# EasyEDA Pro project FOX_HTOL_1.0.eprj, board PCB1
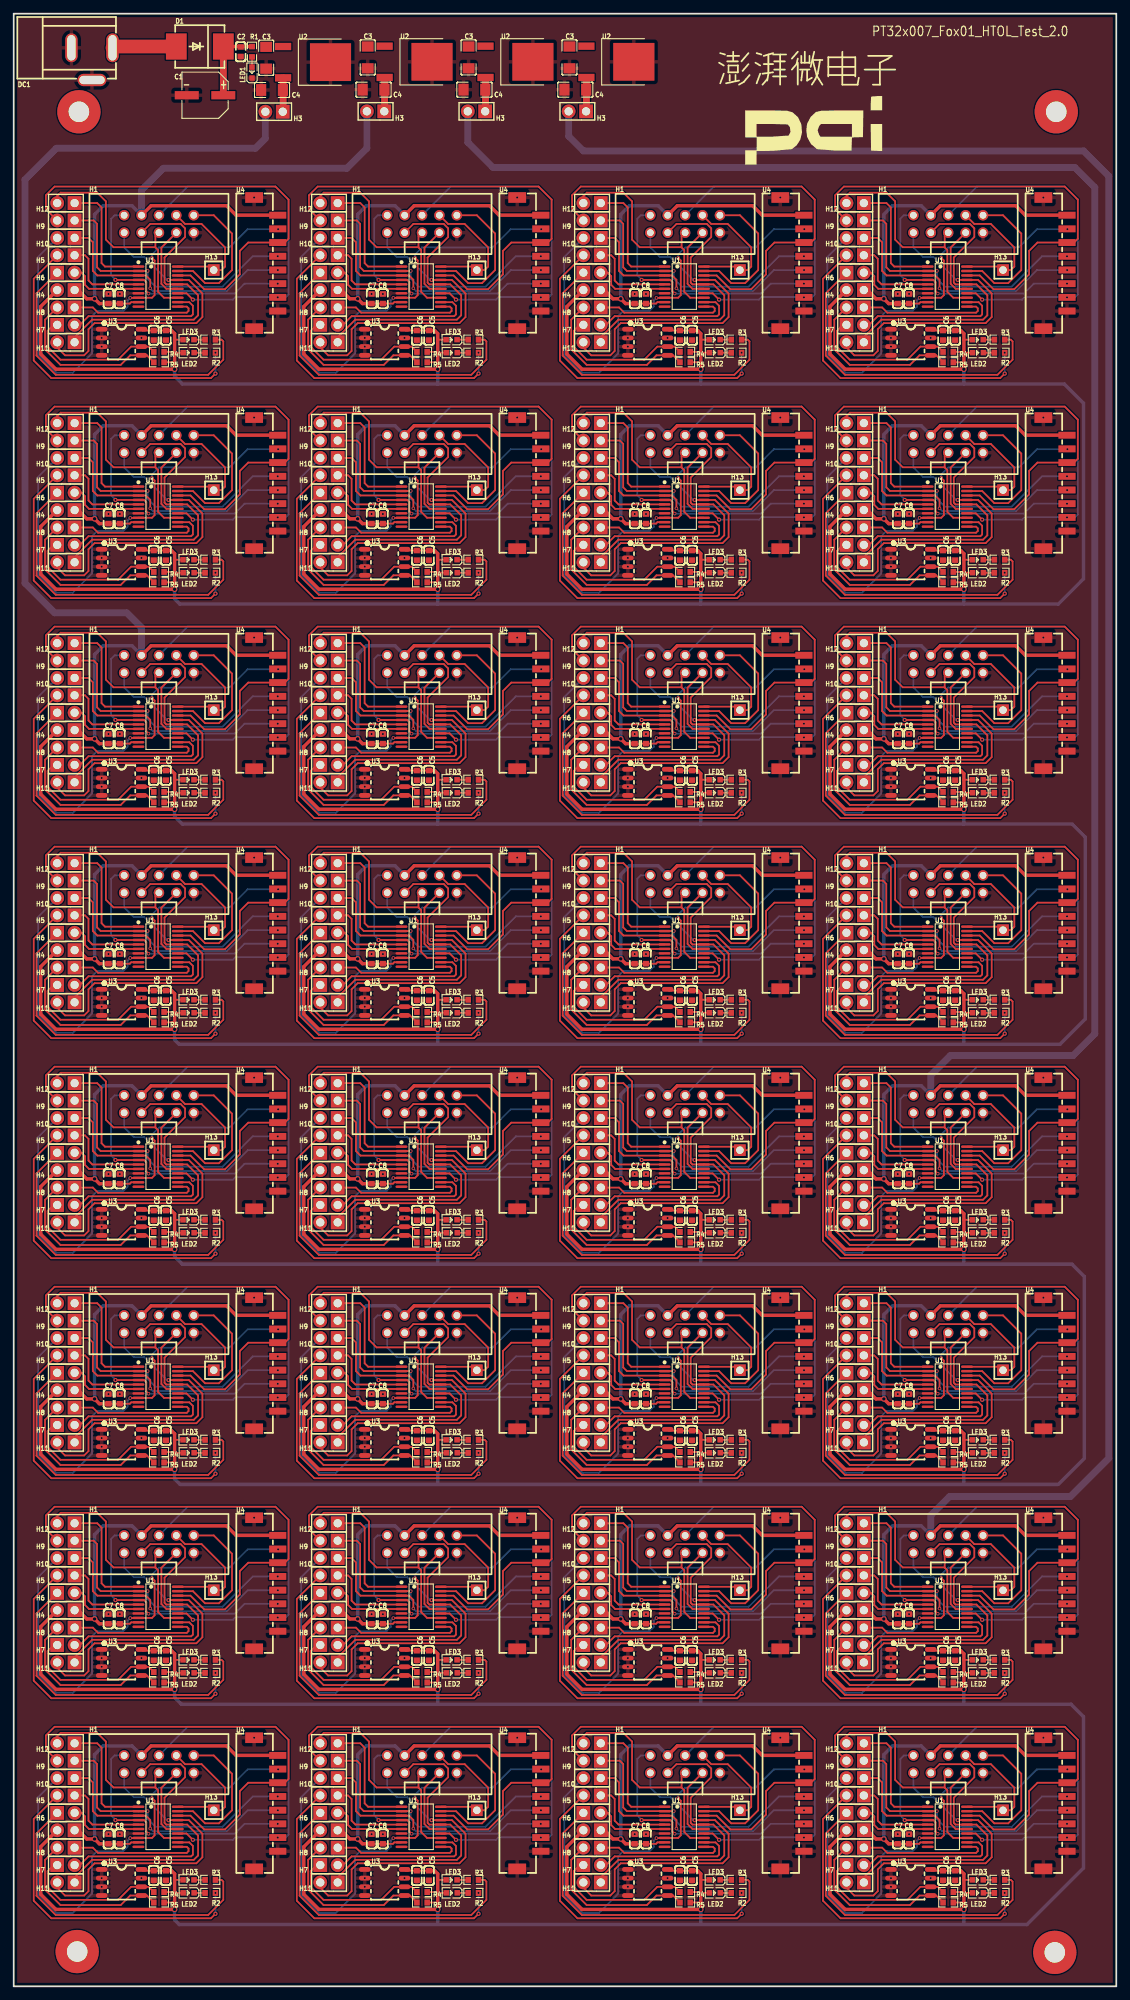
[diagram p1: board, top side]
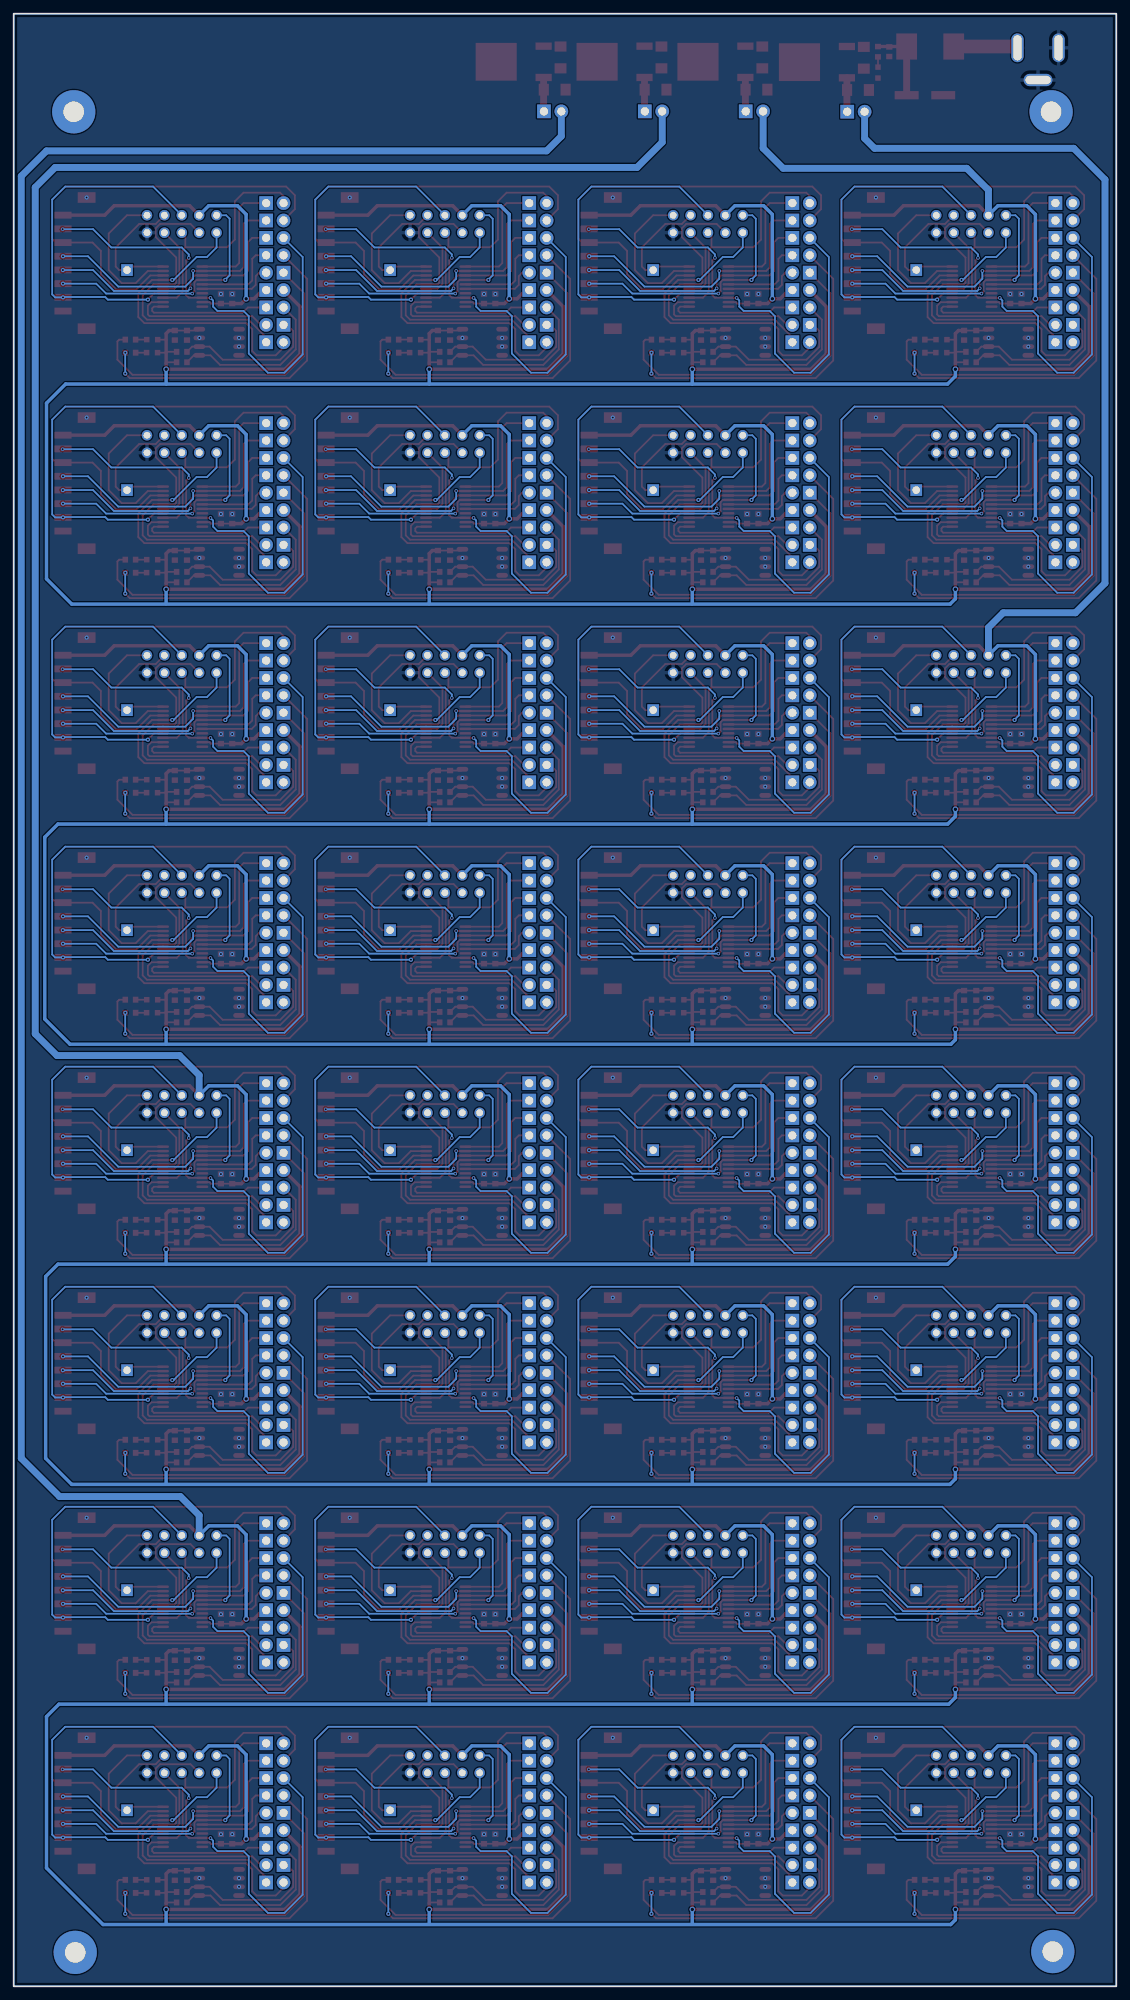
[diagram p2: board, bottom side, seen from below]

Outline 161 x 288 mm; copper layers: Top Layer, Bottom Layer. Coordinates in mm from the lower left corner of the outline.
Outline path: rectangle 0,288 161,0
Stack: Top Layer 0.035mm / Dielectric1 1.51mm FR4 er 4.5 / Bottom Layer 0.035mm

## Design rules (mm)
template: 自定义配置
spacing copperThickness1oz (default): track to track 0.102, other pairs 0.152 to 0.3
spacing copperThickness2oz: track to track 0.203, other pairs 0.152 to 0.3
track width copperThickness1oz (default): min 0.127, default 0.254, max 2.54
track width copperThickness2oz: min 0.203, default 0.254, max 2.54
differential pair differentialPair (default): width min 0.127, default 0.254, max 2.54; gap min 0.152, default 0.152
via viaSize (default): diameter min 0.5, default 0.61, max 10; hole min 0.3, default 0.305, max 6.3

## Placement (name value [footprint] x y rotation side)
C1  100uF  [CAP-SMD_BD6.3-L6.6-W6.6-LS7.6-FD-1]  27.94 276.1 180 top
C2  100nF  [C0603]  33.15 282.45 90 top
C3  10uF  [C1206]  51.69 281.62 270 top
C3#2  -  [C1206]  66.42 281.62 270 top
C3#3  -  [C1206]  36.87 281.57 270 top
C3#4  -  [C1206]  81.15 281.62 270 top
C4  10uF  [C1206]  52.54 276.91 0 top
C4#2  -  [C1206]  67.27 276.91 0 top
C4#3  -  [C1206]  37.72 276.86 0 top
C4#4  -  [C1206]  82.01 276.91 0 top
C5  10uF  [C0603]  99.06 16.17 270 top
C5#2  -  [C0603]  99.06 144.67 270 top
C5#3  -  [C0603]  99.06 112.55 270 top
C5#4  -  [C0603]  99.06 208.92 270 top
C5#5  -  [C0603]  22.23 241.05 270 top
C5#6  -  [C0603]  99.06 176.8 270 top
C5#7  -  [C0603]  99.06 48.3 270 top
C5#8  -  [C0603]  99.06 80.42 270 top
C5#9  -  [C0603]  99.06 241.05 270 top
C5#10  -  [C0603]  137.47 16.17 270 top
C5#11  -  [C0603]  137.47 144.67 270 top
C5#12  -  [C0603]  137.47 112.55 270 top
C5#13  -  [C0603]  137.47 208.92 270 top
C5#14  -  [C0603]  137.47 176.8 270 top
C5#15  -  [C0603]  137.47 48.3 270 top
C5#16  -  [C0603]  137.47 80.42 270 top
C5#17  -  [C0603]  137.47 241.05 270 top
C5#18  -  [C0603]  22.23 176.8 270 top
C5#19  -  [C0603]  22.23 144.67 270 top
C5#20  -  [C0603]  22.23 16.17 270 top
C5#21  -  [C0603]  22.23 80.42 270 top
C5#22  -  [C0603]  22.23 48.3 270 top
C5#23  -  [C0603]  22.23 112.55 270 top
C5#24  -  [C0603]  60.64 16.17 270 top
C5#25  -  [C0603]  60.64 144.67 270 top
C5#26  -  [C0603]  60.64 112.55 270 top
C5#27  -  [C0603]  22.23 208.92 270 top
C5#28  -  [C0603]  60.64 208.92 270 top
C5#29  -  [C0603]  60.64 176.8 270 top
C5#30  -  [C0603]  60.64 48.3 270 top
C5#31  -  [C0603]  60.64 80.42 270 top
C5#32  -  [C0603]  60.64 241.05 270 top
C6  100nF  [C0603]  20.45 241.05 270 top
C6#2  -  [C0603]  97.28 80.42 270 top
C6#3  -  [C0603]  97.28 208.92 270 top
C6#4  -  [C0603]  97.28 112.55 270 top
C6#5  -  [C0603]  97.28 176.8 270 top
C6#6  -  [C0603]  97.28 144.67 270 top
C6#7  -  [C0603]  97.28 48.3 270 top
C6#8  -  [C0603]  97.28 16.17 270 top
C6#9  -  [C0603]  97.28 241.05 270 top
C6#10  -  [C0603]  135.69 80.42 270 top
C6#11  -  [C0603]  135.69 208.92 270 top
C6#12  -  [C0603]  135.69 112.55 270 top
C6#13  -  [C0603]  135.69 176.8 270 top
C6#14  -  [C0603]  135.69 144.67 270 top
C6#15  -  [C0603]  135.69 48.3 270 top
C6#16  -  [C0603]  135.69 16.17 270 top
C6#17  -  [C0603]  135.69 241.05 270 top
C6#18  -  [C0603]  20.45 176.8 270 top
C6#19  -  [C0603]  20.45 144.67 270 top
C6#20  -  [C0603]  20.45 16.17 270 top
C6#21  -  [C0603]  20.45 80.42 270 top
C6#22  -  [C0603]  20.45 48.3 270 top
C6#23  -  [C0603]  20.45 112.55 270 top
C6#24  -  [C0603]  58.86 80.42 270 top
C6#25  -  [C0603]  58.86 208.92 270 top
C6#26  -  [C0603]  58.86 112.55 270 top
C6#27  -  [C0603]  20.45 208.92 270 top
C6#28  -  [C0603]  58.86 176.8 270 top
C6#29  -  [C0603]  58.86 144.67 270 top
C6#30  -  [C0603]  58.86 48.3 270 top
C6#31  -  [C0603]  58.86 16.17 270 top
C6#32  -  [C0603]  58.86 241.05 270 top
C7  10uF  [C0603]  90.68 117.88 270 top
C7#2  -  [C0603]  90.68 21.51 270 top
C7#3  -  [C0603]  90.68 214.26 270 top
C7#4  -  [C0603]  90.68 53.63 270 top
C7#5  -  [C0603]  90.68 246.38 270 top
C7#6  -  [C0603]  90.68 150.01 270 top
C7#7  -  [C0603]  90.68 85.76 270 top
C7#8  -  [C0603]  13.84 182.13 270 top
C7#9  -  [C0603]  90.68 182.13 270 top
C7#10  -  [C0603]  129.09 117.88 270 top
C7#11  -  [C0603]  129.09 21.51 270 top
C7#12  -  [C0603]  129.09 214.26 270 top
C7#13  -  [C0603]  129.09 53.63 270 top
C7#14  -  [C0603]  129.09 246.38 270 top
C7#15  -  [C0603]  129.09 150.01 270 top
C7#16  -  [C0603]  129.09 85.76 270 top
C7#17  -  [C0603]  129.09 182.13 270 top
C7#18  -  [C0603]  13.84 150.01 270 top
C7#19  -  [C0603]  13.84 246.38 270 top
C7#20  -  [C0603]  13.84 85.76 270 top
C7#21  -  [C0603]  13.84 21.51 270 top
C7#22  -  [C0603]  13.84 53.63 270 top
C7#23  -  [C0603]  13.84 117.88 270 top
C7#24  -  [C0603]  13.84 214.26 270 top
C7#25  -  [C0603]  52.26 117.88 270 top
C7#26  -  [C0603]  52.26 21.51 270 top
C7#27  -  [C0603]  52.26 214.26 270 top
C7#28  -  [C0603]  52.26 53.63 270 top
C7#29  -  [C0603]  52.26 246.38 270 top
C7#30  -  [C0603]  52.26 150.01 270 top
C7#31  -  [C0603]  52.26 85.76 270 top
C7#32  -  [C0603]  52.26 182.13 270 top
C8  100nF  [C0603]  92.33 117.88 270 top
C8#2  -  [C0603]  92.33 21.51 270 top
C8#3  -  [C0603]  92.33 53.63 270 top
C8#4  -  [C0603]  92.33 214.26 270 top
C8#5  -  [C0603]  92.33 182.13 270 top
C8#6  -  [C0603]  92.33 85.76 270 top
C8#7  -  [C0603]  15.49 182.13 270 top
C8#8  -  [C0603]  92.33 246.38 270 top
C8#9  -  [C0603]  92.33 150.01 270 top
C8#10  -  [C0603]  130.74 117.88 270 top
C8#11  -  [C0603]  130.74 21.51 270 top
C8#12  -  [C0603]  130.74 53.63 270 top
C8#13  -  [C0603]  130.74 214.26 270 top
C8#14  -  [C0603]  130.74 182.13 270 top
C8#15  -  [C0603]  130.74 85.76 270 top
C8#16  -  [C0603]  130.74 246.38 270 top
C8#17  -  [C0603]  130.74 150.01 270 top
C8#18  -  [C0603]  15.49 150.01 270 top
C8#19  -  [C0603]  15.49 246.38 270 top
C8#20  -  [C0603]  15.49 85.76 270 top
C8#21  -  [C0603]  15.49 53.63 270 top
C8#22  -  [C0603]  15.49 21.51 270 top
C8#23  -  [C0603]  15.49 117.88 270 top
C8#24  -  [C0603]  15.49 214.26 270 top
C8#25  -  [C0603]  53.91 117.88 270 top
C8#26  -  [C0603]  53.91 21.51 270 top
C8#27  -  [C0603]  53.91 53.63 270 top
C8#28  -  [C0603]  53.91 214.26 270 top
C8#29  -  [C0603]  53.91 182.13 270 top
C8#30  -  [C0603]  53.91 85.76 270 top
C8#31  -  [C0603]  53.91 246.38 270 top
C8#32  -  [C0603]  53.91 150.01 270 top
D1  SS36-E3/57T  [SMC_L7.1-W6.2-LS8.1-R-RD]  27.18 283.21 180 top
DC1  DC-005-2.5A-2.0  [CONN-TH_DC-005-2.5A-2.0]  11.43 280.67 0 top
H1  2.54-2*5P简牛  [IDC-TH_10P-P2.54_C5665]  98.04 96.68 0 top
H1#2  -  [IDC-TH_10P-P2.54_C5665]  98.04 32.43 0 top
H1#3  -  [IDC-TH_10P-P2.54_C5665]  98.04 128.8 0 top
H1#4  -  [IDC-TH_10P-P2.54_C5665]  98.04 257.3 0 top
H1#5  -  [IDC-TH_10P-P2.54_C5665]  98.04 225.18 0 top
H1#6  -  [IDC-TH_10P-P2.54_C5665]  98.04 193.05 0 top
H1#7  -  [IDC-TH_10P-P2.54_C5665]  98.04 160.93 0 top
H1#8  -  [IDC-TH_10P-P2.54_C5665]  136.46 64.56 0 top
H1#9  -  [IDC-TH_10P-P2.54_C5665]  136.46 32.43 0 top
H1#10  -  [IDC-TH_10P-P2.54_C5665]  136.46 128.8 0 top
H1#11  -  [IDC-TH_10P-P2.54_C5665]  136.46 257.3 0 top
H1#12  -  [IDC-TH_10P-P2.54_C5665]  136.46 225.18 0 top
H1#13  -  [IDC-TH_10P-P2.54_C5665]  136.46 193.05 0 top
H1#14  -  [IDC-TH_10P-P2.54_C5665]  136.46 160.93 0 top
H1#15  -  [IDC-TH_10P-P2.54_C5665]  136.46 96.68 0 top
H1#16  -  [IDC-TH_10P-P2.54_C5665]  21.21 160.93 0 top
H1#17  -  [IDC-TH_10P-P2.54_C5665]  21.21 32.43 0 top
H1#18  -  [IDC-TH_10P-P2.54_C5665]  21.21 96.68 0 top
H1#19  -  [IDC-TH_10P-P2.54_C5665]  21.21 64.56 0 top
H1#20  -  [IDC-TH_10P-P2.54_C5665]  21.21 128.8 0 top
H1#21  -  [IDC-TH_10P-P2.54_C5665]  21.21 225.18 0 top
H1#22  -  [IDC-TH_10P-P2.54_C5665]  59.62 64.56 0 top
H1#23  -  [IDC-TH_10P-P2.54_C5665]  59.62 32.43 0 top
H1#24  -  [IDC-TH_10P-P2.54_C5665]  59.62 128.8 0 top
H1#25  -  [IDC-TH_10P-P2.54_C5665]  21.21 257.3 0 top
H1#26  -  [IDC-TH_10P-P2.54_C5665]  59.62 257.3 0 top
H1#27  -  [IDC-TH_10P-P2.54_C5665]  59.62 225.18 0 top
H1#28  -  [IDC-TH_10P-P2.54_C5665]  59.62 193.05 0 top
H1#29  -  [IDC-TH_10P-P2.54_C5665]  59.62 160.93 0 top
H1#30  -  [IDC-TH_10P-P2.54_C5665]  59.62 96.68 0 top
H1#31  -  [IDC-TH_10P-P2.54_C5665]  21.21 193.05 0 top
H1#32  -  [IDC-TH_10P-P2.54_C5665]  98.04 64.56 0 top
H3  PZ254V-11-02P  [HDR-TH_2P-P2.54-V-M]  52.84 273.74 180 top
H3#2  -  [HDR-TH_2P-P2.54-V-M]  67.57 273.74 180 top
H3#3  -  [HDR-TH_2P-P2.54-V-M]  82.31 273.74 180 top
H3#4  -  [HDR-TH_2P-P2.54-V-M]  38.02 273.69 180 top
H4  PZ254V-11-02P  [HDR-TH_2P-P2.54-V-M]  84.45 119.15 180 top
H4#2  -  [HDR-TH_2P-P2.54-V-M]  84.45 22.78 180 top
H4#3  -  [HDR-TH_2P-P2.54-V-M]  84.45 215.53 180 top
H4#4  -  [HDR-TH_2P-P2.54-V-M]  84.45 151.28 180 top
H4#5  -  [HDR-TH_2P-P2.54-V-M]  84.45 54.9 180 top
H4#6  -  [HDR-TH_2P-P2.54-V-M]  84.45 183.4 180 top
H4#7  -  [HDR-TH_2P-P2.54-V-M]  84.45 87.03 180 top
H4#8  -  [HDR-TH_2P-P2.54-V-M]  84.45 247.65 180 top
H4#9  -  [HDR-TH_2P-P2.54-V-M]  122.87 119.15 180 top
H4#10  -  [HDR-TH_2P-P2.54-V-M]  122.87 22.78 180 top
H4#11  -  [HDR-TH_2P-P2.54-V-M]  122.87 215.53 180 top
H4#12  -  [HDR-TH_2P-P2.54-V-M]  122.87 151.28 180 top
H4#13  -  [HDR-TH_2P-P2.54-V-M]  122.87 54.9 180 top
H4#14  -  [HDR-TH_2P-P2.54-V-M]  122.87 183.4 180 top
H4#15  -  [HDR-TH_2P-P2.54-V-M]  122.87 87.03 180 top
H4#16  -  [HDR-TH_2P-P2.54-V-M]  122.87 247.65 180 top
H4#17  -  [HDR-TH_2P-P2.54-V-M]  7.62 183.4 180 top
H4#18  -  [HDR-TH_2P-P2.54-V-M]  7.62 151.28 180 top
H4#19  -  [HDR-TH_2P-P2.54-V-M]  7.62 22.78 180 top
H4#20  -  [HDR-TH_2P-P2.54-V-M]  7.62 87.03 180 top
H4#21  -  [HDR-TH_2P-P2.54-V-M]  7.62 54.9 180 top
H4#22  -  [HDR-TH_2P-P2.54-V-M]  7.62 119.15 180 top
H4#23  -  [HDR-TH_2P-P2.54-V-M]  46.04 119.15 180 top
H4#24  -  [HDR-TH_2P-P2.54-V-M]  46.04 22.78 180 top
H4#25  -  [HDR-TH_2P-P2.54-V-M]  7.62 215.53 180 top
H4#26  -  [HDR-TH_2P-P2.54-V-M]  46.04 215.53 180 top
H4#27  -  [HDR-TH_2P-P2.54-V-M]  46.04 151.28 180 top
H4#28  -  [HDR-TH_2P-P2.54-V-M]  46.04 54.9 180 top
H4#29  -  [HDR-TH_2P-P2.54-V-M]  46.04 183.4 180 top
H4#30  -  [HDR-TH_2P-P2.54-V-M]  46.04 87.03 180 top
H4#31  -  [HDR-TH_2P-P2.54-V-M]  46.04 247.65 180 top
H4#32  -  [HDR-TH_2P-P2.54-V-M]  7.62 247.65 180 top
H5  PZ254V-11-02P  [HDR-TH_2P-P2.54-V-M]  84.45 124.23 180 top
H5#2  -  [HDR-TH_2P-P2.54-V-M]  84.45 27.86 180 top
H5#3  -  [HDR-TH_2P-P2.54-V-M]  84.45 220.61 180 top
H5#4  -  [HDR-TH_2P-P2.54-V-M]  84.45 156.36 180 top
H5#5  -  [HDR-TH_2P-P2.54-V-M]  84.45 188.48 180 top
H5#6  -  [HDR-TH_2P-P2.54-V-M]  84.45 92.11 180 top
H5#7  -  [HDR-TH_2P-P2.54-V-M]  84.45 59.98 180 top
H5#8  -  [HDR-TH_2P-P2.54-V-M]  84.45 252.73 180 top
H5#9  -  [HDR-TH_2P-P2.54-V-M]  122.87 124.23 180 top
H5#10  -  [HDR-TH_2P-P2.54-V-M]  122.87 27.86 180 top
H5#11  -  [HDR-TH_2P-P2.54-V-M]  122.87 220.61 180 top
H5#12  -  [HDR-TH_2P-P2.54-V-M]  122.87 156.36 180 top
H5#13  -  [HDR-TH_2P-P2.54-V-M]  122.87 188.48 180 top
H5#14  -  [HDR-TH_2P-P2.54-V-M]  122.87 92.11 180 top
H5#15  -  [HDR-TH_2P-P2.54-V-M]  122.87 59.98 180 top
H5#16  -  [HDR-TH_2P-P2.54-V-M]  122.87 252.73 180 top
H5#17  -  [HDR-TH_2P-P2.54-V-M]  7.62 188.48 180 top
H5#18  -  [HDR-TH_2P-P2.54-V-M]  7.62 156.36 180 top
H5#19  -  [HDR-TH_2P-P2.54-V-M]  7.62 27.86 180 top
H5#20  -  [HDR-TH_2P-P2.54-V-M]  7.62 92.11 180 top
H5#21  -  [HDR-TH_2P-P2.54-V-M]  7.62 59.98 180 top
H5#22  -  [HDR-TH_2P-P2.54-V-M]  7.62 124.23 180 top
H5#23  -  [HDR-TH_2P-P2.54-V-M]  46.04 124.23 180 top
H5#24  -  [HDR-TH_2P-P2.54-V-M]  46.04 27.86 180 top
H5#25  -  [HDR-TH_2P-P2.54-V-M]  46.04 220.61 180 top
H5#26  -  [HDR-TH_2P-P2.54-V-M]  7.62 220.61 180 top
H5#27  -  [HDR-TH_2P-P2.54-V-M]  46.04 156.36 180 top
H5#28  -  [HDR-TH_2P-P2.54-V-M]  46.04 188.48 180 top
H5#29  -  [HDR-TH_2P-P2.54-V-M]  46.04 92.11 180 top
H5#30  -  [HDR-TH_2P-P2.54-V-M]  46.04 59.98 180 top
H5#31  -  [HDR-TH_2P-P2.54-V-M]  46.04 252.73 180 top
H5#32  -  [HDR-TH_2P-P2.54-V-M]  7.62 252.73 180 top
H6  PZ254V-11-02P  [HDR-TH_2P-P2.54-V-M]  84.45 121.69 0 top
H6#2  -  [HDR-TH_2P-P2.54-V-M]  84.45 25.32 0 top
H6#3  -  [HDR-TH_2P-P2.54-V-M]  84.45 89.57 0 top
H6#4  -  [HDR-TH_2P-P2.54-V-M]  84.45 218.07 0 top
H6#5  -  [HDR-TH_2P-P2.54-V-M]  84.45 153.82 0 top
H6#6  -  [HDR-TH_2P-P2.54-V-M]  84.45 185.94 0 top
H6#7  -  [HDR-TH_2P-P2.54-V-M]  84.45 57.44 0 top
H6#8  -  [HDR-TH_2P-P2.54-V-M]  84.45 250.19 0 top
H6#9  -  [HDR-TH_2P-P2.54-V-M]  122.87 121.69 0 top
H6#10  -  [HDR-TH_2P-P2.54-V-M]  122.87 25.32 0 top
H6#11  -  [HDR-TH_2P-P2.54-V-M]  122.87 89.57 0 top
H6#12  -  [HDR-TH_2P-P2.54-V-M]  122.87 218.07 0 top
H6#13  -  [HDR-TH_2P-P2.54-V-M]  122.87 153.82 0 top
H6#14  -  [HDR-TH_2P-P2.54-V-M]  122.87 185.94 0 top
H6#15  -  [HDR-TH_2P-P2.54-V-M]  122.87 57.44 0 top
H6#16  -  [HDR-TH_2P-P2.54-V-M]  122.87 250.19 0 top
H6#17  -  [HDR-TH_2P-P2.54-V-M]  7.62 185.94 0 top
H6#18  -  [HDR-TH_2P-P2.54-V-M]  7.62 153.82 0 top
H6#19  -  [HDR-TH_2P-P2.54-V-M]  7.62 25.32 0 top
H6#20  -  [HDR-TH_2P-P2.54-V-M]  7.62 89.57 0 top
H6#21  -  [HDR-TH_2P-P2.54-V-M]  7.62 57.44 0 top
H6#22  -  [HDR-TH_2P-P2.54-V-M]  7.62 121.69 0 top
H6#23  -  [HDR-TH_2P-P2.54-V-M]  46.04 121.69 0 top
H6#24  -  [HDR-TH_2P-P2.54-V-M]  46.04 25.32 0 top
H6#25  -  [HDR-TH_2P-P2.54-V-M]  46.04 89.57 0 top
H6#26  -  [HDR-TH_2P-P2.54-V-M]  7.62 218.07 0 top
H6#27  -  [HDR-TH_2P-P2.54-V-M]  46.04 218.07 0 top
H6#28  -  [HDR-TH_2P-P2.54-V-M]  46.04 153.82 0 top
H6#29  -  [HDR-TH_2P-P2.54-V-M]  46.04 185.94 0 top
H6#30  -  [HDR-TH_2P-P2.54-V-M]  46.04 57.44 0 top
H6#31  -  [HDR-TH_2P-P2.54-V-M]  46.04 250.19 0 top
H6#32  -  [HDR-TH_2P-P2.54-V-M]  7.62 250.19 0 top
H7  PZ254V-11-02P  [HDR-TH_2P-P2.54-V-M]  84.45 17.7 0 top
H7#2  -  [HDR-TH_2P-P2.54-V-M]  84.45 146.2 0 top
H7#3  -  [HDR-TH_2P-P2.54-V-M]  84.45 114.07 0 top
H7#4  -  [HDR-TH_2P-P2.54-V-M]  84.45 49.82 0 top
H7#5  -  [HDR-TH_2P-P2.54-V-M]  84.45 81.95 0 top
H7#6  -  [HDR-TH_2P-P2.54-V-M]  7.62 242.57 0 top
H7#7  -  [HDR-TH_2P-P2.54-V-M]  84.45 242.57 0 top
H7#8  -  [HDR-TH_2P-P2.54-V-M]  84.45 210.45 0 top
H7#9  -  [HDR-TH_2P-P2.54-V-M]  84.45 178.32 0 top
H7#10  -  [HDR-TH_2P-P2.54-V-M]  122.87 17.7 0 top
H7#11  -  [HDR-TH_2P-P2.54-V-M]  122.87 146.2 0 top
H7#12  -  [HDR-TH_2P-P2.54-V-M]  122.87 114.07 0 top
H7#13  -  [HDR-TH_2P-P2.54-V-M]  122.87 49.82 0 top
H7#14  -  [HDR-TH_2P-P2.54-V-M]  122.87 81.95 0 top
H7#15  -  [HDR-TH_2P-P2.54-V-M]  122.87 242.57 0 top
H7#16  -  [HDR-TH_2P-P2.54-V-M]  7.62 178.32 0 top
H7#17  -  [HDR-TH_2P-P2.54-V-M]  122.87 210.45 0 top
H7#18  -  [HDR-TH_2P-P2.54-V-M]  122.87 178.32 0 top
H7#19  -  [HDR-TH_2P-P2.54-V-M]  7.62 146.2 0 top
H7#20  -  [HDR-TH_2P-P2.54-V-M]  7.62 17.7 0 top
H7#21  -  [HDR-TH_2P-P2.54-V-M]  7.62 81.95 0 top
H7#22  -  [HDR-TH_2P-P2.54-V-M]  7.62 49.82 0 top
H7#23  -  [HDR-TH_2P-P2.54-V-M]  7.62 114.07 0 top
H7#24  -  [HDR-TH_2P-P2.54-V-M]  7.62 210.45 0 top
H7#25  -  [HDR-TH_2P-P2.54-V-M]  46.04 17.7 0 top
H7#26  -  [HDR-TH_2P-P2.54-V-M]  46.04 146.2 0 top
H7#27  -  [HDR-TH_2P-P2.54-V-M]  46.04 114.07 0 top
H7#28  -  [HDR-TH_2P-P2.54-V-M]  46.04 49.82 0 top
H7#29  -  [HDR-TH_2P-P2.54-V-M]  46.04 81.95 0 top
H7#30  -  [HDR-TH_2P-P2.54-V-M]  46.04 242.57 0 top
H7#31  -  [HDR-TH_2P-P2.54-V-M]  46.04 210.45 0 top
H7#32  -  [HDR-TH_2P-P2.54-V-M]  46.04 178.32 0 top
H8  PZ254V-11-02P  [HDR-TH_2P-P2.54-V-M]  84.45 116.61 180 top
H8#2  -  [HDR-TH_2P-P2.54-V-M]  84.45 20.24 180 top
H8#3  -  [HDR-TH_2P-P2.54-V-M]  84.45 212.99 180 top
H8#4  -  [HDR-TH_2P-P2.54-V-M]  84.45 148.74 180 top
H8#5  -  [HDR-TH_2P-P2.54-V-M]  84.45 84.49 180 top
H8#6  -  [HDR-TH_2P-P2.54-V-M]  84.45 52.36 180 top
H8#7  -  [HDR-TH_2P-P2.54-V-M]  84.45 245.11 180 top
H8#8  -  [HDR-TH_2P-P2.54-V-M]  7.62 245.11 180 top
H8#9  -  [HDR-TH_2P-P2.54-V-M]  84.45 180.86 180 top
H8#10  -  [HDR-TH_2P-P2.54-V-M]  122.87 116.61 180 top
H8#11  -  [HDR-TH_2P-P2.54-V-M]  122.87 20.24 180 top
H8#12  -  [HDR-TH_2P-P2.54-V-M]  122.87 212.99 180 top
H8#13  -  [HDR-TH_2P-P2.54-V-M]  122.87 148.74 180 top
H8#14  -  [HDR-TH_2P-P2.54-V-M]  122.87 84.49 180 top
H8#15  -  [HDR-TH_2P-P2.54-V-M]  122.87 52.36 180 top
H8#16  -  [HDR-TH_2P-P2.54-V-M]  122.87 245.11 180 top
H8#17  -  [HDR-TH_2P-P2.54-V-M]  7.62 180.86 180 top
H8#18  -  [HDR-TH_2P-P2.54-V-M]  122.87 180.86 180 top
H8#19  -  [HDR-TH_2P-P2.54-V-M]  7.62 148.74 180 top
H8#20  -  [HDR-TH_2P-P2.54-V-M]  7.62 20.24 180 top
H8#21  -  [HDR-TH_2P-P2.54-V-M]  7.62 84.49 180 top
H8#22  -  [HDR-TH_2P-P2.54-V-M]  7.62 52.36 180 top
H8#23  -  [HDR-TH_2P-P2.54-V-M]  7.62 116.61 180 top
H8#24  -  [HDR-TH_2P-P2.54-V-M]  7.62 212.99 180 top
H8#25  -  [HDR-TH_2P-P2.54-V-M]  46.04 116.61 180 top
H8#26  -  [HDR-TH_2P-P2.54-V-M]  46.04 20.24 180 top
H8#27  -  [HDR-TH_2P-P2.54-V-M]  46.04 212.99 180 top
H8#28  -  [HDR-TH_2P-P2.54-V-M]  46.04 148.74 180 top
H8#29  -  [HDR-TH_2P-P2.54-V-M]  46.04 84.49 180 top
H8#30  -  [HDR-TH_2P-P2.54-V-M]  46.04 52.36 180 top
H8#31  -  [HDR-TH_2P-P2.54-V-M]  46.04 245.11 180 top
H8#32  -  [HDR-TH_2P-P2.54-V-M]  46.04 180.86 180 top
H9  PZ254V-11-02P  [HDR-TH_2P-P2.54-V-M]  122.87 32.94 180 top
H9#2  -  [HDR-TH_2P-P2.54-V-M]  84.45 129.31 180 top
H9#3  -  [HDR-TH_2P-P2.54-V-M]  84.45 225.69 180 top
H9#4  -  [HDR-TH_2P-P2.54-V-M]  84.45 32.94 180 top
H9#5  -  [HDR-TH_2P-P2.54-V-M]  84.45 257.81 180 top
H9#6  -  [HDR-TH_2P-P2.54-V-M]  84.45 161.44 180 top
H9#7  -  [HDR-TH_2P-P2.54-V-M]  84.45 97.19 180 top
H9#8  -  [HDR-TH_2P-P2.54-V-M]  84.45 65.06 180 top
H9#9  -  [HDR-TH_2P-P2.54-V-M]  84.45 193.56 180 top
H9#10  -  [HDR-TH_2P-P2.54-V-M]  7.62 257.81 180 top
H9#11  -  [HDR-TH_2P-P2.54-V-M]  122.87 129.31 180 top
H9#12  -  [HDR-TH_2P-P2.54-V-M]  122.87 225.69 180 top
H9#13  -  [HDR-TH_2P-P2.54-V-M]  122.87 257.81 180 top
H9#14  -  [HDR-TH_2P-P2.54-V-M]  122.87 161.44 180 top
H9#15  -  [HDR-TH_2P-P2.54-V-M]  122.87 97.19 180 top
H9#16  -  [HDR-TH_2P-P2.54-V-M]  122.87 65.06 180 top
H9#17  -  [HDR-TH_2P-P2.54-V-M]  122.87 193.56 180 top
H9#18  -  [HDR-TH_2P-P2.54-V-M]  7.62 193.56 180 top
H9#19  -  [HDR-TH_2P-P2.54-V-M]  7.62 161.44 180 top
H9#20  -  [HDR-TH_2P-P2.54-V-M]  7.62 32.94 180 top
H9#21  -  [HDR-TH_2P-P2.54-V-M]  7.62 97.19 180 top
H9#22  -  [HDR-TH_2P-P2.54-V-M]  7.62 65.06 180 top
H9#23  -  [HDR-TH_2P-P2.54-V-M]  7.62 129.31 180 top
H9#24  -  [HDR-TH_2P-P2.54-V-M]  46.04 129.31 180 top
H9#25  -  [HDR-TH_2P-P2.54-V-M]  46.04 225.69 180 top
H9#26  -  [HDR-TH_2P-P2.54-V-M]  46.04 32.94 180 top
H9#27  -  [HDR-TH_2P-P2.54-V-M]  46.04 257.81 180 top
H9#28  -  [HDR-TH_2P-P2.54-V-M]  7.62 225.69 180 top
H9#29  -  [HDR-TH_2P-P2.54-V-M]  46.04 161.44 180 top
H9#30  -  [HDR-TH_2P-P2.54-V-M]  46.04 97.19 180 top
H9#31  -  [HDR-TH_2P-P2.54-V-M]  46.04 65.06 180 top
H9#32  -  [HDR-TH_2P-P2.54-V-M]  46.04 193.56 180 top
H10  PZ254V-11-02P  [HDR-TH_2P-P2.54-V-M]  84.45 126.77 180 top
H10#2  -  [HDR-TH_2P-P2.54-V-M]  84.45 255.27 180 top
H10#3  -  [HDR-TH_2P-P2.54-V-M]  84.45 223.15 180 top
H10#4  -  [HDR-TH_2P-P2.54-V-M]  84.45 158.9 180 top
H10#5  -  [HDR-TH_2P-P2.54-V-M]  84.45 62.52 180 top
H10#6  -  [HDR-TH_2P-P2.54-V-M]  84.45 30.4 180 top
H10#7  -  [HDR-TH_2P-P2.54-V-M]  84.45 191.02 180 top
H10#8  -  [HDR-TH_2P-P2.54-V-M]  84.45 94.65 180 top
H10#9  -  [HDR-TH_2P-P2.54-V-M]  7.62 255.27 180 top
H10#10  -  [HDR-TH_2P-P2.54-V-M]  122.87 126.77 180 top
H10#11  -  [HDR-TH_2P-P2.54-V-M]  122.87 255.27 180 top
H10#12  -  [HDR-TH_2P-P2.54-V-M]  122.87 223.15 180 top
H10#13  -  [HDR-TH_2P-P2.54-V-M]  122.87 158.9 180 top
H10#14  -  [HDR-TH_2P-P2.54-V-M]  122.87 62.52 180 top
H10#15  -  [HDR-TH_2P-P2.54-V-M]  122.87 30.4 180 top
H10#16  -  [HDR-TH_2P-P2.54-V-M]  122.87 191.02 180 top
H10#17  -  [HDR-TH_2P-P2.54-V-M]  122.87 94.65 180 top
H10#18  -  [HDR-TH_2P-P2.54-V-M]  7.62 191.02 180 top
H10#19  -  [HDR-TH_2P-P2.54-V-M]  7.62 158.9 180 top
H10#20  -  [HDR-TH_2P-P2.54-V-M]  7.62 30.4 180 top
H10#21  -  [HDR-TH_2P-P2.54-V-M]  7.62 94.65 180 top
H10#22  -  [HDR-TH_2P-P2.54-V-M]  7.62 62.52 180 top
H10#23  -  [HDR-TH_2P-P2.54-V-M]  7.62 126.77 180 top
H10#24  -  [HDR-TH_2P-P2.54-V-M]  46.04 126.77 180 top
H10#25  -  [HDR-TH_2P-P2.54-V-M]  46.04 255.27 180 top
H10#26  -  [HDR-TH_2P-P2.54-V-M]  46.04 223.15 180 top
H10#27  -  [HDR-TH_2P-P2.54-V-M]  7.62 223.15 180 top
H10#28  -  [HDR-TH_2P-P2.54-V-M]  46.04 158.9 180 top
H10#29  -  [HDR-TH_2P-P2.54-V-M]  46.04 62.52 180 top
H10#30  -  [HDR-TH_2P-P2.54-V-M]  46.04 30.4 180 top